# EasyEDA Pro project YanQi_Project.eprj, board PayloadBoard (continued)
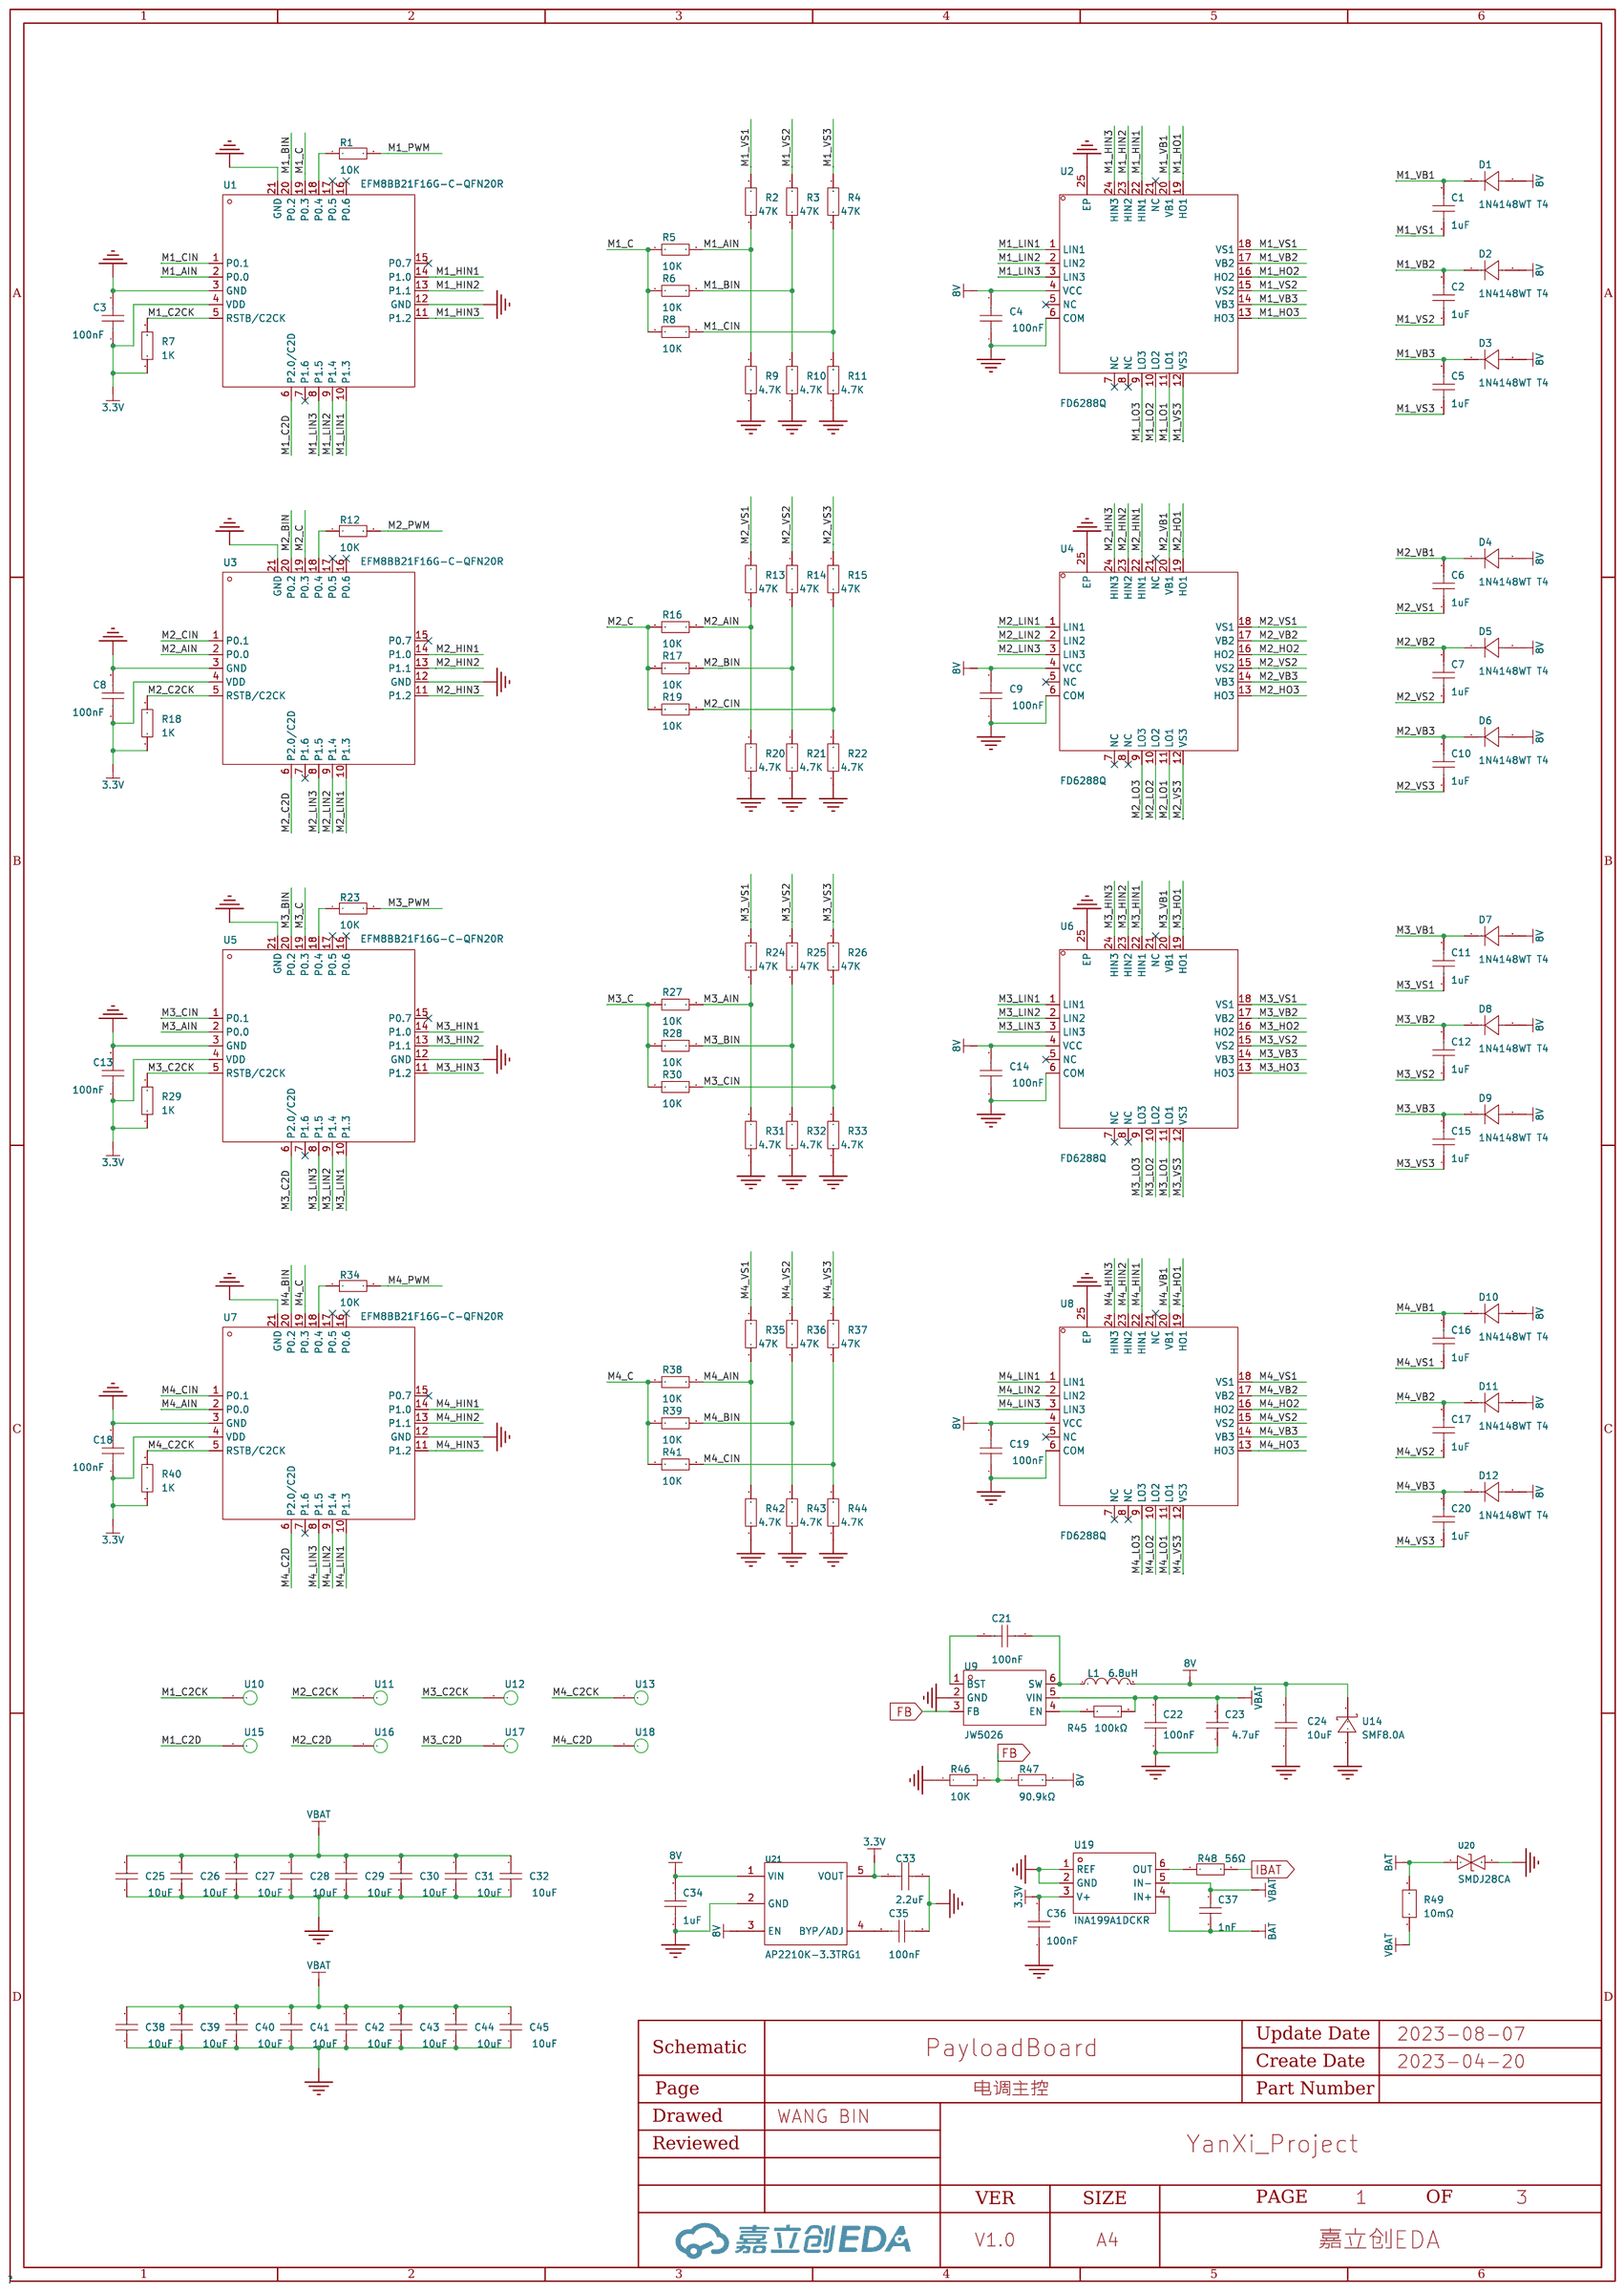
[diagram p0: 电调主控]
## Routing (per net, layer and track width the routed paths; a pad name or vN(x,y) marks a point on that pad's centre or on a via; arc(x,y) is an arc through that point) (continued)
$1N9645: length 3.7
  Top Layer w0.254: R1.1 85.3,65.27 85.3,63.75 85.8,63.25 U1.18
$1N9747: length 3.7
  Top Layer w0.254: R12.1 13.1,52.73 13.1,54.25 12.6,54.75 U3.18
$1N9849: length 3.7
  Top Layer w0.254: R23.1 2.63,65.27 2.63,63.75 3.13,63.25 U5.18
$1N9951: length 3.7
  Top Layer w0.254: R34.1 95.77,52.73 95.77,54.25 95.27,54.75 U7.18
$1N15748: length 3.5
  Top Layer w0.5: U9.1 71.75,81.75 72.6,82.6 73.95,82.6 C21.2
$1N20032: length 4.5
  Top Layer w0.5: U9.6 74.75,81.75 75.55,82.55 C21.1 77.27,83.1 L1.1
$1N20137: length 1.4
  Top Layer w0.5: U9.4 74.25,79.08 73.8,78.63
$1N21202: length 1.8
  Top Layer w0.254: 32.1,79.13 32.1,80.7 U19.6
$1N30363: length 1.7
  Top Layer w0.5: U21.4 84.1,78.45 C35.2
$2N5483: length 36
  Bottom Layer w0.254: LED7.2 82.7,37.5 61.9,37.5 59.3,40.1 59.3,43.3 59.7,43.7 60.3,43.7 60.7,43.3 60.7,40.48 61.69,39.5 LED6.4
$2N5486: length 23.9
  Bottom Layer w0.254: LED8.2 86.4,56.5 86,56.1 86,53.07 83.22,50.29 83.22,41.02 81.7,39.5 LED7.4
$2N5490: length 10.7
  Bottom Layer w0.254: LED9.2 92.4,61.5 91.68,60.78 91.68,54.12 92.3,53.5 LED8.4
$2N5494: length 22.1
  Bottom Layer w0.254: LED10.2 78.9,81.5 83.62,76.78 83.62,67.65 86.77,64.5 LED9.4
$2N5524: length 26.2
  Bottom Layer w0.254: LED2.4 12.6,61.5 13.5,60.6 14.8,60.6 15.12,60.92 15.12,75.72 17.9,78.5 LED1.2
$2N5542: length 17.4
  Bottom Layer w0.254: LED3.2 12.2,53.5 14.95,50.75 14.95,41.15 14.7,40.9 LED4.4
$2N5548: length 11.7
  Bottom Layer w0.254: LED3.4 3.1,56.5 2.4,57.2 2.4,60.1 3.8,61.5 3.8,64.07 4.23,64.5 LED2.2
$2N5554: length 17.6
  Bottom Layer w0.254: LED5.4 33.8,34.6 21.6,34.6 LED4.2

## Copper pours and planes (outline as drawn; the poured copper is in the pictures)
GND on Top Layer: -0.8,100 99.2,100 99.2,0 -0.8,0
GND on Bottom Layer: -0.8,100 99.2,100 99.2,0 -0.8,0
GND on Inner1: -0.8,100 99.2,100 99.2,0 -0.8,0
GND on Inner2: -0.8,100 99.2,100 99.2,0 -0.8,0
VBAT on Top Layer: 17.2,66.8 1.32,66.8 1.32,70.7 17.2,70.7
VBAT on Top Layer: 97.1,66.8 81.23,66.8 81.23,70.7 97.1,70.7
VBAT on Top Layer: 1.3,51.2 17.17,51.2 17.17,47.3 1.3,47.3
VBAT on Top Layer: 81.2,51.2 97.08,51.2 97.08,47.3 81.2,47.3
BAT on Top Layer: 48.9,100.3 48.9,93.5 37.3,93.5 35.4,91.6 35.4,84 34.2,82.8 31.41,82.8 30.99,82.38 30.99,80.8 14.1,80.8 14.1,100.3
BAT on Inner1: 48.9,100.3 48.9,93.5 37.3,93.5 35.4,91.6 35.4,84 34.2,82.8 31.41,82.8 30.99,82.38 30.99,80.8 14.1,80.8 14.1,100.3
BAT on Inner2: 48.9,100.3 48.9,93.5 37.3,93.5 35.4,91.6 35.4,84 34.2,82.8 31.41,82.8 30.99,82.38 30.99,80.8 14.1,80.8 14.1,100.3
M1_VS1 on Top Layer: 94.6,75.3 97.2,75.3 97.2,71.1 94.6,71.1
M1_VS1 on Bottom Layer: 94.6,75.3 97.2,75.3 97.2,69.3 94.6,69.3
M1_VS2 on Top Layer: 89.6,75.3 92.2,75.3 92.2,71.1 89.6,71.1
M1_VS2 on Bottom Layer: 89.6,75.3 92.2,75.3 92.2,69.3 89.6,69.3
M1_VS3 on Top Layer: 84.6,75.3 87.2,75.3 87.2,71.1 84.6,71.1
M1_VS3 on Bottom Layer: 84.6,75.3 87.2,75.3 87.2,69.3 84.6,69.3
M2_VS1 on Top Layer: 1.2,46.9 3.8,46.9 3.8,42.7 1.2,42.7
M2_VS1 on Bottom Layer: 1.2,48.7 3.8,48.7 3.8,42.7 1.2,42.7
M2_VS2 on Top Layer: 6.2,46.9 8.8,46.9 8.8,42.7 6.2,42.7
M2_VS2 on Bottom Layer: 6.2,48.7 8.8,48.7 8.8,42.7 6.2,42.7
M2_VS3 on Top Layer: 11.2,46.9 13.8,46.9 13.8,42.7 11.2,42.7
M2_VS3 on Bottom Layer: 11.2,48.7 13.8,48.7 13.8,42.7 11.2,42.7
M3_VS1 on Top Layer: 11.2,75.3 13.8,75.3 13.8,71.1 11.2,71.1
M3_VS1 on Bottom Layer: 11.2,75.3 13.8,75.3 13.8,69.3 11.2,69.3
M3_VS2 on Top Layer: 6.2,75.3 8.8,75.3 8.8,71.1 6.2,71.1
M3_VS2 on Bottom Layer: 6.2,75.3 8.8,75.3 8.8,69.3 6.2,69.3
M3_VS3 on Top Layer: 1.2,75.3 3.8,75.3 3.8,71.1 1.2,71.1
M3_VS3 on Bottom Layer: 1.2,75.3 3.8,75.3 3.8,69.3 1.2,69.3
M4_VS1 on Top Layer: 84.6,46.9 87.2,46.9 87.2,42.7 84.6,42.7
M4_VS1 on Bottom Layer: 84.6,48.7 87.2,48.7 87.2,42.7 84.6,42.7
M4_VS2 on Top Layer: 89.6,46.9 92.2,46.9 92.2,42.7 89.6,42.7
M4_VS2 on Bottom Layer: 89.6,48.7 92.2,48.7 92.2,42.7 89.6,42.7
M4_VS3 on Top Layer: 94.6,46.9 97.2,46.9 97.2,42.7 94.6,42.7
M4_VS3 on Bottom Layer: 94.6,48.7 97.2,48.7 97.2,42.7 94.6,42.7

## Text on the board
Bottom Silkscreen Layer: PROJECT | 雁栖
Top Silkscreen Layer: PROJECT | 雁栖
